# Altium schematic sheet Minion.SchDoc (part 2 of 4)
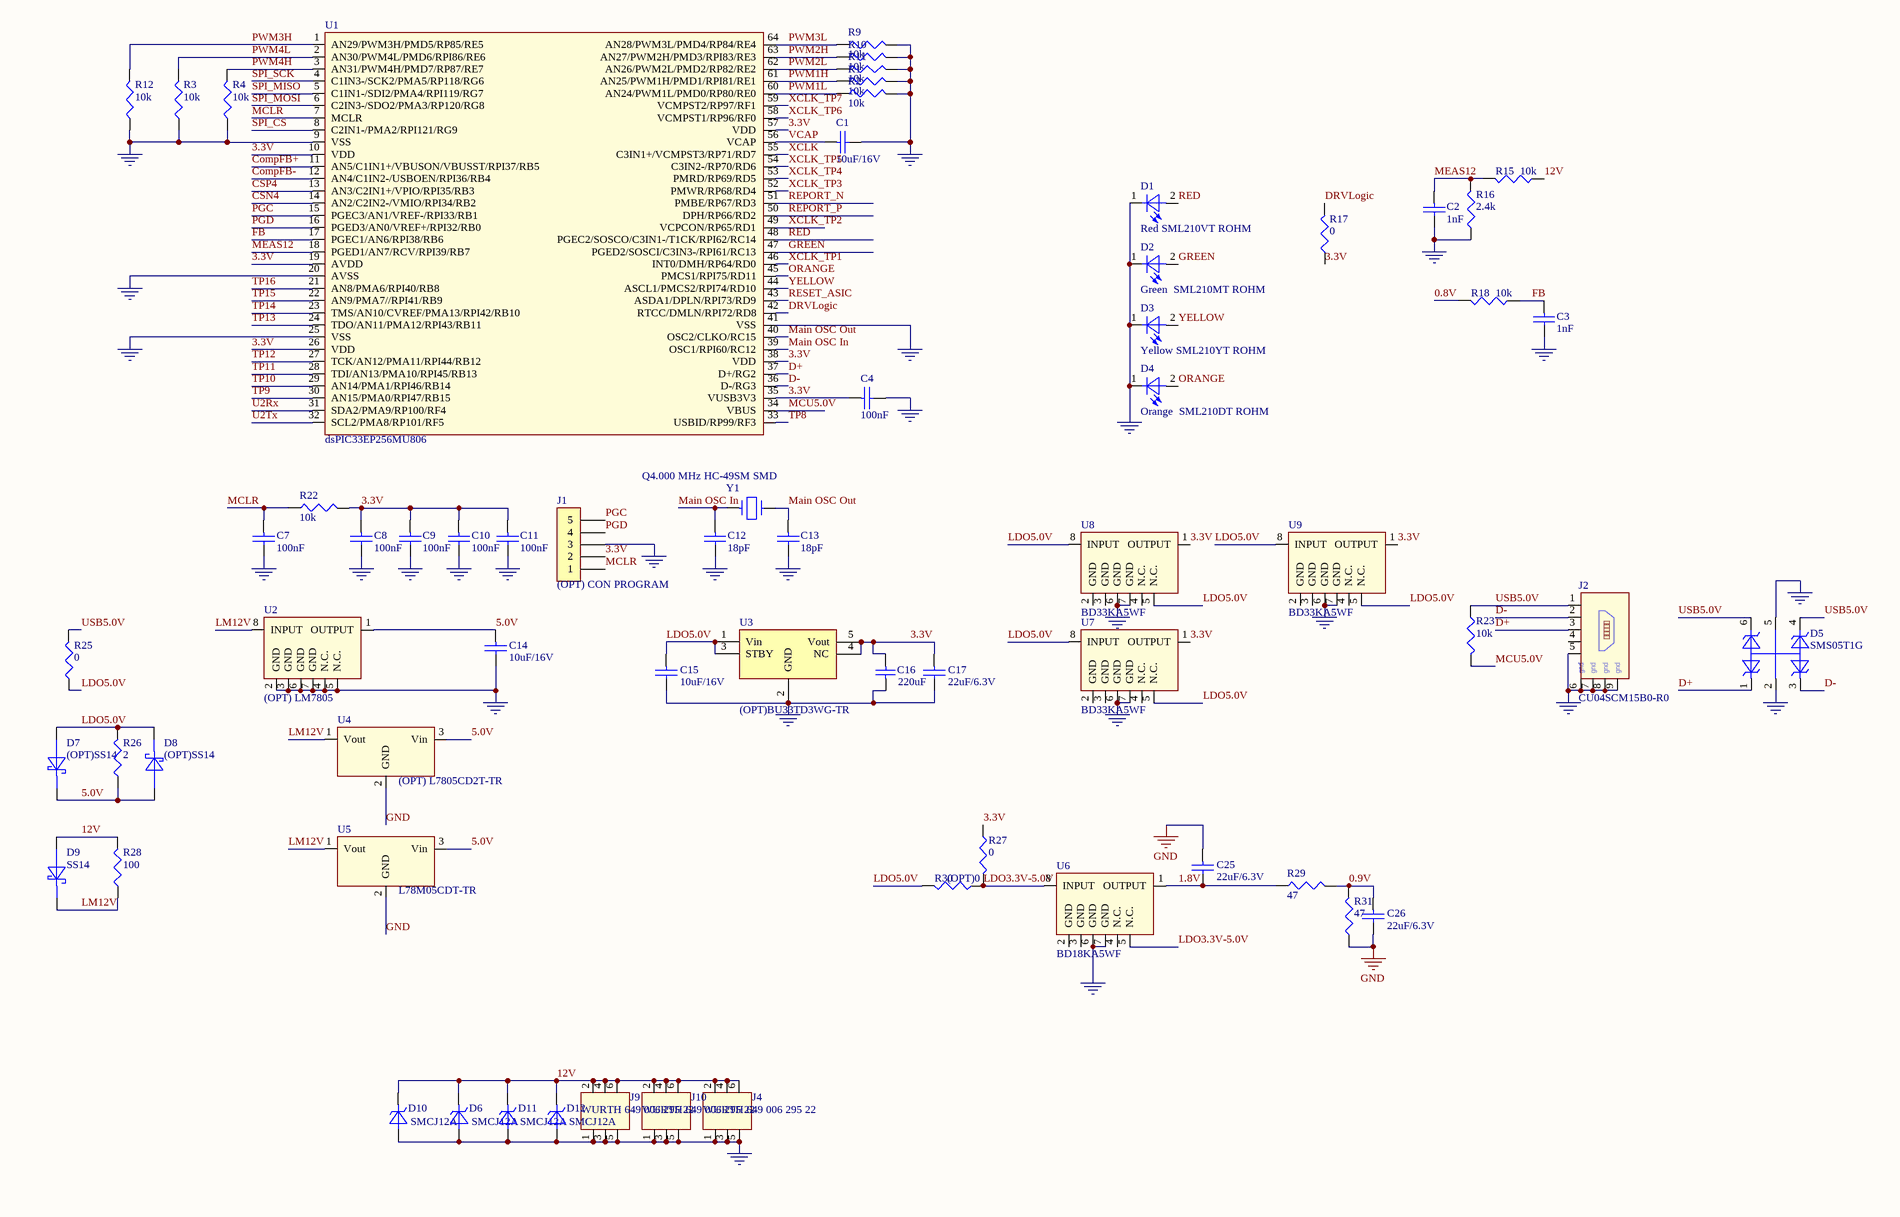
[diagram p6: Minion.SchDoc, bottom right]
## Nets
0.8V: C6P_1.1 C6P_2.1 C6P_3.1 C6P_4.1 C6P_5.1 C6P_6.1 C6P_7.1 C6P_8.1 C7P_1.1 C7P_2.1 C7P_3.1 C7P_4.1 C7P_5.1 C7P_6.1 C7P_7.1 C7P_8.1 C8P_1.1 C8P_2.1 C8P_3.1 C8P_4.1 C8P_5.1 C8P_6.1 C8P_7.1 C8P_8.1 CF_1.1 CF_2.1 CF_3.1 CF_4.1 CF_5.1 CF_6.1 CF_7.1 CF_8.1 CF_9.1 CF_10.1 CF_11.1 CF_12.1 CF_13.1 CF_14.1 CF_15.1 CF_16.1 CF_17.1 CF_18.1 CF_19.1 CF_20.1 CF_21.1 CF_22.1 CF_23.1 CF_24.1 CF_25.1 CF_26.1 CF_27.1 CF_28.1 CF_29.1 CF_30.1 CF_31.1 CF_32.1 CF_33.1 CF_34.1 CF_35.1 CF_36.1 CF_37.1 CF_38.1 CF_39.1 CF_40.1 CF_41.1 CF_42.1 CF_43.1 CF_44.1 CF_45.1 CF_46.1 CF_47.1 CF_48.1 CF_49.1 CF_50.1 CF_51.1 CF_52.1 CF_53.1 CF_54.1 CF_55.1 CF_56.1 CF_57.1 CF_58.1 CF_59.1 CF_60.1 CF_61.1 CF_62.1 CF_63.1 CF_64.1 CF_65.1 CF_66.1 CF_67.1 CF_68.1 CF_69.1 CF_70.1 CF_71.1 CF_72.1 CF_73.1 CF_74.1 CF_75.1 CF_76.1 CF_77.1 CF_78.1 CF_79.1 CF_80.1 CF_81.1 CF_82.1 CF_83.1 CF_84.1 CF_85.1 CF_86.1 CF_87.1 CF_88.1 CF_89.1 CF_90.1 CF_91.1 CF_92.1 CF_93.1 CF_94.1 CF_95.1 CF_96.1 CF_97.1 CF_98.1 CF_99.1 CF_100.1 CF_101.1 CF_102.1 CF_103.1 CF_104.1 CF_105.1 CF_106.1 CF_107.1 CF_108.1 CF_109.1 CF_110.1 CF_111.1 CF_112.1 CM_1.1 CM_2.1 CM_3.1 CM_4.1 CM_5.1 CM_6.1 CM_7.1 CM_8.1 CM_9.1 CM_10.1 CM_11.1 CM_12.1 CM_13.1 CM_14.1 CM_15.1 CM_16.1 CM_17.1 CM_18.1 CM_19.1 CM_20.1 CM_21.1 CM_22.1 CM_23.1 CM_24.1 CM_25.1 CM_26.1 CM_27.1 CM_28.1 CM_29.1 CM_30.1 CM_31.1 CM_32.1 CM_33.1 CM_34.1 CM_35.1 CM_36.1 CM_37.1 CM_38.1 CM_39.1 CM_40.1 CM_41.1 CM_42.1 CM_43.1 CM_44.1 CM_45.1 CM_46.1 CM_47.1 CM_48.1 CM_49.1 CM_50.1 CM_51.1 CM_52.1 CM_53.1 CM_54.1 CM_55.1 CM_56.1 CM_57.1 CM_58.1 CM_59.1 CM_60.1 CM_61.1 CM_62.1 CM_63.1 CM_64.1 CM_65.1 CM_66.1 CM_67.1 CM_68.1 CM_69.1 CM_70.1 CM_71.1 CM_72.1 CM_73.1 CM_74.1 CM_75.1 CM_76.1 CM_77.1 CM_78.1 CM_79.1 CM_80.1 CM_81.1 CM_82.1 CM_83.1 CM_84.1 CM_85.1 CM_86.1 CM_87.1 CM_88.1 CM_89.1 CM_90.1 CM_91.1 CM_92.1 CM_93.1 CM_94.1 CM_95.1 CM_96.1 CM_97.1 CM_98.1 CM_99.1 CM_100.1 CM_101.1 CM_102.1 CM_103.1 CM_104.1 CM_105.1 CM_106.1 CM_107.1 CM_108.1 CM_109.1 CM_110.1 CM_111.1 CM_112.1 L1P_1.2 L1P_2.2 L1P_3.2 L1P_4.2 L1P_5.2 L1P_6.2 L1P_7.2 L1P_8.2 R18.2 U1_1.A2(CORE_VDD) U1_1.A4(CORE_VDD) U1_1.A6(CORE_VDD) U1_1.A8(CORE_VDD) U1_1.A10(CORE_VDD) U1_1.A12(CORE_VDD) U1_1.A14(CORE_VDD) U1_1.A16(CORE_VDD) U1_1.A18(CORE_VDD) U1_1.A20(CORE_VDD) U1_1.A22(CORE_VDD) U1_1.A24(CORE_VDD) U1_1.A26(CORE_VDD) U1_1.A28(CORE_VDD) U1_1.A30(CORE_VDD) U1_1.AA2(CORE_VDD) U1_1.AA4(CORE_VDD) U1_1.AA6(CORE_VDD) U1_1.AA8(CORE_VDD) U1_1.AA10(CORE_VDD) U1_1.AA12(CORE_VDD) U1_1.AA14(CORE_VDD) U1_1.AA16(CORE_VDD) U1_1.AA18(CORE_VDD) U1_1.AA20(CORE_VDD) U1_1.AA22(CORE_VDD) U1_1.AA24(CORE_VDD) U1_1.AA26(CORE_VDD) U1_1.AA28(CORE_VDD) U1_1.AA30(CORE_VDD) U1_1.AB1(CORE_VDD) U1_1.AB3(CORE_VDD) U1_1.AB5(CORE_VDD) U1_1.AB7(CORE_VDD) U1_1.AB9(CORE_VDD) U1_1.AB11(CORE_VDD) U1_1.AB13(CORE_VDD) U1_1.AB15(CORE_VDD) U1_1.AB17(CORE_VDD) U1_1.AB19(CORE_VDD) U1_1.AB21(CORE_VDD) U1_1.AB23(CORE_VDD) U1_1.AB25(CORE_VDD) U1_1.AB27(CORE_VDD) U1_1.AB29(CORE_VDD) U1_1.AC2(CORE_VDD) U1_1.AC4(CORE_VDD) U1_1.AC6(CORE_VDD) U1_1.AC8(CORE_VDD) U1_1.AC10(CORE_VDD) U1_1.AC12(CORE_VDD) U1_1.AC14(CORE_VDD) U1_1.AC16(CORE_VDD) U1_1.AC18(CORE_VDD) U1_1.AC20(CORE_VDD) U1_1.AC22(CORE_VDD) U1_1.AC24(CORE_VDD) U1_1.AC26(CORE_VDD) U1_1.AC28(CORE_VDD) U1_1.AC30(CORE_VDD) U1_1.AD1(CORE_VDD) U1_1.AD3(CORE_VDD) U1_1.AD5(CORE_VDD) U1_1.AD7(CORE_VDD) U1_1.AD9(CORE_VDD) U1_1.AD11(CORE_VDD) U1_1.AD13(CORE_VDD) U1_1.AD15(CORE_VDD) U1_1.AD17(CORE_VDD) U1_1.AD19(CORE_VDD) U1_1.AD21(CORE_VDD) U1_1.AD23(CORE_VDD) U1_1.AD25(CORE_VDD) U1_1.AD27(CORE_VDD) U1_1.AD29(CORE_VDD) U1_1.AE2(CORE_VDD) U1_1.AE4(CORE_VDD) U1_1.AE6(CORE_VDD) U1_1.AE8(CORE_VDD) U1_1.AE10(CORE_VDD) U1_1.AE12(CORE_VDD) U1_1.AE14(CORE_VDD) U1_1.AE16(CORE_VDD) U1_1.AE18(CORE_VDD) U1_1.AE20(CORE_VDD) U1_1.AE22(CORE_VDD) U1_1.AE24(CORE_VDD) U1_1.AE26(CORE_VDD) U1_1.AE28(CORE_VDD) U1_1.AE30(CORE_VDD) U1_1.AF1(CORE_VDD) U1_1.AF3(CORE_VDD) U1_1.AF5(CORE_VDD) U1_1.AF7(CORE_VDD) U1_1.AF9(CORE_VDD) U1_1.AF11(CORE_VDD) U1_1.AF13(CORE_VDD) U1_1.AF15(CORE_VDD) U1_1.AF17(CORE_VDD) U1_1.AF19(CORE_VDD) U1_1.AF21(CORE_VDD) U1_1.AF23(CORE_VDD) U1_1.AF25(CORE_VDD) U1_1.AF27(CORE_VDD) U1_1.AF29(CORE_VDD) U1_1.AG2(CORE_VDD) U1_1.AG4(CORE_VDD) U1_1.AG6(CORE_VDD) U1_1.AG8(CORE_VDD) U1_1.AG10(CORE_VDD) U1_1.AG12(CORE_VDD) U1_1.AG14(CORE_VDD) U1_1.AG16(CORE_VDD) U1_1.AG18(CORE_VDD) U1_1.AG20(CORE_VDD) U1_1.AG22(CORE_VDD) U1_1.AG24(CORE_VDD) U1_1.AG26(CORE_VDD) U1_1.AG28(CORE_VDD) U1_1.AG30(CORE_VDD) U1_1.AH1(CORE_VDD) U1_1.AH3(CORE_VDD) U1_1.AH5(CORE_VDD) U1_1.AH7(CORE_VDD) U1_1.AH9(CORE_VDD) U1_1.AH11(CORE_VDD) U1_1.AH13(CORE_VDD) U1_1.AH15(CORE_VDD) U1_1.AH17(CORE_VDD) U1_1.AH19(CORE_VDD) U1_1.AH21(CORE_VDD) U1_1.AH23(CORE_VDD) U1_1.AH25(CORE_VDD) U1_1.AH27(CORE_VDD) U1_1.AH29(CORE_VDD) U1_1.AJ2(CORE_VDD) U1_1.AJ10(CORE_VDD) U1_1.AJ14(CORE_VDD) U1_1.AJ18(CORE_VDD) U1_1.AJ28(CORE_VDD) U1_1.AJ30(CORE_VDD) U1_1.AK1(CORE_VDD) U1_1.AK26(CORE_VDD) U1_1.AK29(CORE_VDD) U1_1.B1(CORE_VDD) U1_1.B3(CORE_VDD) U1_1.B5(CORE_VDD) U1_1.B7(CORE_VDD) U1_1.B9(CORE_VDD) U1_1.B11(CORE_VDD) U1_1.B13(CORE_VDD) U1_1.B15(CORE_VDD) U1_1.B17(CORE_VDD) U1_1.B19(CORE_VDD) U1_1.B21(CORE_VDD) U1_1.B23(CORE_VDD) U1_1.B25(CORE_VDD) U1_1.B27(CORE_VDD) U1_1.B29(CORE_VDD) U1_1.C2(CORE_VDD) U1_1.C4(CORE_VDD) U1_1.C6(CORE_VDD) U1_1.C8(CORE_VDD) U1_1.C10(CORE_VDD) U1_1.C12(CORE_VDD) U1_1.C14(CORE_VDD) U1_1.C16(CORE_VDD) U1_1.C18(CORE_VDD) U1_1.C20(CORE_VDD) U1_1.C22(CORE_VDD) U1_1.C24(CORE_VDD) U1_1.C26(CORE_VDD) U1_1.C28(CORE_VDD) U1_1.C30(CORE_VDD) U1_1.D1(CORE_VDD) U1_1.D3(CORE_VDD) U1_1.D5(CORE_VDD) U1_1.D7(CORE_VDD) U1_1.D9(CORE_VDD) U1_1.D11(CORE_VDD) U1_1.D13(CORE_VDD) U1_1.D15(CORE_VDD) U1_1.D17(CORE_VDD) U1_1.D19(CORE_VDD) U1_1.D21(CORE_VDD) U1_1.D23(CORE_VDD) U1_1.D25(CORE_VDD) U1_1.D27(CORE_VDD) U1_1.D29(CORE_VDD) U1_1.E2(CORE_VDD) U1_1.E4(CORE_VDD) U1_1.E6(CORE_VDD) U1_1.E8(CORE_VDD) U1_1.E10(CORE_VDD) U1_1.E12(CORE_VDD) U1_1.E14(CORE_VDD) U1_1.E16(CORE_VDD) U1_1.E18(CORE_VDD) U1_1.E20(CORE_VDD) U1_1.E22(CORE_VDD) U1_1.E24(CORE_VDD) U1_1.E26(CORE_VDD) U1_1.E28(CORE_VDD) U1_1.E30(CORE_VDD) U1_1.F1(CORE_VDD) U1_1.F3(CORE_VDD) U1_1.F5(CORE_VDD) U1_1.F7(CORE_VDD) U1_1.F9(CORE_VDD) U1_1.F11(CORE_VDD) U1_1.F13(CORE_VDD) U1_1.F15(CORE_VDD) U1_1.F17(CORE_VDD) U1_1.F19(CORE_VDD) U1_1.F21(CORE_VDD) U1_1.F23(CORE_VDD) U1_1.F25(CORE_VDD) U1_1.F27(CORE_VDD) U1_1.F29(CORE_VDD) U1_1.G2(CORE_VDD) U1_1.G4(CORE_VDD) U1_1.G6(CORE_VDD) U1_1.G8(CORE_VDD) U1_1.G10(CORE_VDD) U1_1.G12(CORE_VDD) U1_1.G14(CORE_VDD) U1_1.G16(CORE_VDD) U1_1.G18(CORE_VDD) U1_1.G20(CORE_VDD) U1_1.G22(CORE_VDD) U1_1.G24(CORE_VDD) U1_1.G26(CORE_VDD) U1_1.G28(CORE_VDD) U1_1.G30(CORE_VDD) U1_1.H1(CORE_VDD) U1_1.H3(CORE_VDD) U1_1.H5(CORE_VDD) U1_1.H7(CORE_VDD) U1_1.H9(CORE_VDD) U1_1.H11(CORE_VDD) U1_1.H13(CORE_VDD) U1_1.H15(CORE_VDD) U1_1.H17(CORE_VDD) U1_1.H19(CORE_VDD) U1_1.H21(CORE_VDD) U1_1.H23(CORE_VDD) U1_1.H25(CORE_VDD) U1_1.H27(CORE_VDD) U1_1.H29(CORE_VDD) U1_1.J2(CORE_VDD) U1_1.J4(CORE_VDD) U1_1.J6(CORE_VDD) U1_1.J8(CORE_VDD) U1_1.J10(CORE_VDD) U1_1.J12(CORE_VDD) U1_1.J14(CORE_VDD) U1_1.J16(CORE_VDD) U1_1.J18(CORE_VDD) U1_1.J20(CORE_VDD) U1_1.J22(CORE_VDD) U1_1.J24(CORE_VDD) U1_1.J26(CORE_VDD) U1_1.J28(CORE_VDD) U1_1.J30(CORE_VDD) U1_1.K1(CORE_VDD) U1_1.K3(CORE_VDD) U1_1.K5(CORE_VDD) U1_1.K7(CORE_VDD) U1_1.K9(CORE_VDD) U1_1.K11(CORE_VDD) U1_1.K13(CORE_VDD) U1_1.K15(CORE_VDD) U1_1.K17(CORE_VDD) U1_1.K19(CORE_VDD) U1_1.K21(CORE_VDD) U1_1.K23(CORE_VDD) U1_1.K25(CORE_VDD) U1_1.K27(CORE_VDD) U1_1.K29(CORE_VDD) U1_1.L2(CORE_VDD) U1_1.L4(CORE_VDD) U1_1.L6(CORE_VDD) U1_1.L8(CORE_VDD) U1_1.L10(CORE_VDD) U1_1.L12(CORE_VDD) U1_1.L14(CORE_VDD) U1_1.L16(CORE_VDD) U1_1.L18(CORE_VDD) U1_1.L20(CORE_VDD) U1_1.L22(CORE_VDD) U1_1.L24(CORE_VDD) U1_1.L26(CORE_VDD) U1_1.L28(CORE_VDD) U1_1.L30(CORE_VDD) U1_1.M1(CORE_VDD) U1_1.M3(CORE_VDD) U1_1.M5(CORE_VDD) U1_1.M7(CORE_VDD) U1_1.M9(CORE_VDD) U1_1.M11(CORE_VDD) U1_1.M13(CORE_VDD) U1_1.M15(CORE_VDD) U1_1.M17(CORE_VDD) U1_1.M19(CORE_VDD) U1_1.M21(CORE_VDD) U1_1.M23(CORE_VDD) U1_1.M25(CORE_VDD) U1_1.M27(CORE_VDD) U1_1.M29(CORE_VDD) U1_1.N2(CORE_VDD) U1_1.N4(CORE_VDD) U1_1.N6(CORE_VDD) U1_1.N8(CORE_VDD) U1_1.N10(CORE_VDD) U1_1.N12(CORE_VDD) U1_1.N14(CORE_VDD) U1_1.N16(CORE_VDD) U1_1.N18(CORE_VDD) U1_1.N20(CORE_VDD) U1_1.N22(CORE_VDD) U1_1.N24(CORE_VDD) U1_1.N26(CORE_VDD) U1_1.N28(CORE_VDD) U1_1.N30(CORE_VDD) U1_1.P1(CORE_VDD) U1_1.P3(CORE_VDD) U1_1.P5(CORE_VDD) U1_1.P7(CORE_VDD) U1_1.P9(CORE_VDD) U1_1.P11(CORE_VDD) U1_1.P13(CORE_VDD) U1_1.P15(CORE_VDD) U1_1.P17(CORE_VDD) U1_1.P19(CORE_VDD) U1_1.P21(CORE_VDD) U1_1.P23(CORE_VDD) U1_1.P25(CORE_VDD) U1_1.P27(CORE_VDD) U1_1.P29(CORE_VDD) U1_1.R2(CORE_VDD) U1_1.R4(CORE_VDD) U1_1.R6(CORE_VDD) U1_1.R8(CORE_VDD) U1_1.R10(CORE_VDD) U1_1.R12(CORE_VDD) U1_1.R14(CORE_VDD) U1_1.R16(CORE_VDD) U1_1.R18(CORE_VDD) U1_1.R20(CORE_VDD) U1_1.R22(CORE_VDD) U1_1.R24(CORE_VDD) U1_1.R26(CORE_VDD) U1_1.R28(CORE_VDD) U1_1.R30(CORE_VDD) U1_1.T1(CORE_VDD) U1_1.T3(CORE_VDD) U1_1.T5(CORE_VDD) U1_1.T7(CORE_VDD) U1_1.T9(CORE_VDD) U1_1.T11(CORE_VDD) U1_1.T13(CORE_VDD) U1_1.T15(CORE_VDD) U1_1.T17(CORE_VDD) U1_1.T19(CORE_VDD) U1_1.T21(CORE_VDD) U1_1.T23(CORE_VDD) U1_1.T25(CORE_VDD) U1_1.T27(CORE_VDD) U1_1.T29(CORE_VDD) U1_1.U2(CORE_VDD) U1_1.U4(CORE_VDD) U1_1.U6(CORE_VDD) U1_1.U8(CORE_VDD) U1_1.U10(CORE_VDD) U1_1.U12(CORE_VDD) U1_1.U14(CORE_VDD) U1_1.U16(CORE_VDD) U1_1.U18(CORE_VDD) U1_1.U20(CORE_VDD) U1_1.U22(CORE_VDD) U1_1.U24(CORE_VDD) U1_1.U26(CORE_VDD) U1_1.U28(CORE_VDD) U1_1.U30(CORE_VDD) U1_1.V1(CORE_VDD) U1_1.V3(CORE_VDD) U1_1.V5(CORE_VDD) U1_1.V7(CORE_VDD) U1_1.V9(CORE_VDD) U1_1.V11(CORE_VDD) U1_1.V13(CORE_VDD) U1_1.V15(CORE_VDD) U1_1.V17(CORE_VDD) U1_1.V19(CORE_VDD) U1_1.V21(CORE_VDD) U1_1.V23(CORE_VDD) U1_1.V25(CORE_VDD) U1_1.V27(CORE_VDD) U1_1.V29(CORE_VDD) U1_1.W2(CORE_VDD) U1_1.W4(CORE_VDD) U1_1.W6(CORE_VDD) U1_1.W8(CORE_VDD) U1_1.W10(CORE_VDD) U1_1.W12(CORE_VDD) U1_1.W14(CORE_VDD) U1_1.W16(CORE_VDD) U1_1.W18(CORE_VDD) U1_1.W20(CORE_VDD) U1_1.W22(CORE_VDD) U1_1.W24(CORE_VDD) U1_1.W26(CORE_VDD) U1_1.W28(CORE_VDD) U1_1.W30(CORE_VDD) U1_1.Y1(CORE_VDD) U1_1.Y3(CORE_VDD) U1_1.Y5(CORE_VDD) U1_1.Y7(CORE_VDD) U1_1.Y9(CORE_VDD) U1_1.Y11(CORE_VDD) U1_1.Y13(CORE_VDD) U1_1.Y15(CORE_VDD) U1_1.Y17(CORE_VDD) U1_1.Y19(CORE_VDD) U1_1.Y21(CORE_VDD) U1_1.Y23(CORE_VDD) U1_1.Y25(CORE_VDD) U1_1.Y27(CORE_VDD) U1_1.Y29(CORE_VDD) U1_2.A2(CORE_VDD) U1_2.A4(CORE_VDD) U1_2.A6(CORE_VDD) U1_2.A8(CORE_VDD) U1_2.A10(CORE_VDD) U1_2.A12(CORE_VDD) U1_2.A14(CORE_VDD) U1_2.A16(CORE_VDD) U1_2.A18(CORE_VDD) U1_2.A20(CORE_VDD) U1_2.A22(CORE_VDD) U1_2.A24(CORE_VDD) U1_2.A26(CORE_VDD) U1_2.A28(CORE_VDD) U1_2.A30(CORE_VDD) U1_2.AA2(CORE_VDD) U1_2.AA4(CORE_VDD) U1_2.AA6(CORE_VDD) U1_2.AA8(CORE_VDD) U1_2.AA10(CORE_VDD) U1_2.AA12(CORE_VDD) U1_2.AA14(CORE_VDD) U1_2.AA16(CORE_VDD) U1_2.AA18(CORE_VDD) U1_2.AA20(CORE_VDD) U1_2.AA22(CORE_VDD) U1_2.AA24(CORE_VDD) U1_2.AA26(CORE_VDD) U1_2.AA28(CORE_VDD) U1_2.AA30(CORE_VDD) U1_2.AB1(CORE_VDD) U1_2.AB3(CORE_VDD) U1_2.AB5(CORE_VDD) U1_2.AB7(CORE_VDD) U1_2.AB9(CORE_VDD) U1_2.AB11(CORE_VDD) U1_2.AB13(CORE_VDD) U1_2.AB15(CORE_VDD) U1_2.AB17(CORE_VDD) U1_2.AB19(CORE_VDD) U1_2.AB21(CORE_VDD) U1_2.AB23(CORE_VDD) U1_2.AB25(CORE_VDD) U1_2.AB27(CORE_VDD) U1_2.AB29(CORE_VDD) U1_2.AC2(CORE_VDD) U1_2.AC4(CORE_VDD) U1_2.AC6(CORE_VDD) U1_2.AC8(CORE_VDD) U1_2.AC10(CORE_VDD) U1_2.AC12(CORE_VDD) U1_2.AC14(CORE_VDD) U1_2.AC16(CORE_VDD) U1_2.AC18(CORE_VDD) U1_2.AC20(CORE_VDD) U1_2.AC22(CORE_VDD) U1_2.AC24(CORE_VDD) U1_2.AC26(CORE_VDD) U1_2.AC28(CORE_VDD) U1_2.AC30(CORE_VDD) U1_2.AD1(CORE_VDD) U1_2.AD3(CORE_VDD) U1_2.AD5(CORE_VDD) U1_2.AD7(CORE_VDD) U1_2.AD9(CORE_VDD) U1_2.AD11(CORE_VDD) U1_2.AD13(CORE_VDD) U1_2.AD15(CORE_VDD) U1_2.AD17(CORE_VDD) U1_2.AD19(CORE_VDD) U1_2.AD21(CORE_VDD) U1_2.AD23(CORE_VDD) U1_2.AD25(CORE_VDD) U1_2.AD27(CORE_VDD) U1_2.AD29(CORE_VDD) U1_2.AE2(CORE_VDD) U1_2.AE4(CORE_VDD) U1_2.AE6(CORE_VDD) U1_2.AE8(CORE_VDD) U1_2.AE10(CORE_VDD) U1_2.AE12(CORE_VDD) U1_2.AE14(CORE_VDD) U1_2.AE16(CORE_VDD) U1_2.AE18(CORE_VDD) U1_2.AE20(CORE_VDD) U1_2.AE22(CORE_VDD) U1_2.AE24(CORE_VDD) U1_2.AE26(CORE_VDD) U1_2.AE28(CORE_VDD) U1_2.AE30(CORE_VDD) U1_2.AF1(CORE_VDD) U1_2.AF3(CORE_VDD) U1_2.AF5(CORE_VDD) U1_2.AF7(CORE_VDD) U1_2.AF9(CORE_VDD) U1_2.AF11(CORE_VDD) U1_2.AF13(CORE_VDD) U1_2.AF15(CORE_VDD) U1_2.AF17(CORE_VDD) U1_2.AF19(CORE_VDD) U1_2.AF21(CORE_VDD) U1_2.AF23(CORE_VDD) U1_2.AF25(CORE_VDD) U1_2.AF27(CORE_VDD) U1_2.AF29(CORE_VDD) U1_2.AG2(CORE_VDD) U1_2.AG4(CORE_VDD) U1_2.AG6(CORE_VDD) U1_2.AG8(CORE_VDD) U1_2.AG10(CORE_VDD) U1_2.AG12(CORE_VDD) U1_2.AG14(CORE_VDD) U1_2.AG16(CORE_VDD) U1_2.AG18(CORE_VDD) U1_2.AG20(CORE_VDD) U1_2.AG22(CORE_VDD) U1_2.AG24(CORE_VDD) U1_2.AG26(CORE_VDD) U1_2.AG28(CORE_VDD) U1_2.AG30(CORE_VDD) U1_2.AH1(CORE_VDD) U1_2.AH3(CORE_VDD) U1_2.AH5(CORE_VDD) U1_2.AH7(CORE_VDD) U1_2.AH9(CORE_VDD) U1_2.AH11(CORE_VDD) U1_2.AH13(CORE_VDD) U1_2.AH15(CORE_VDD) U1_2.AH17(CORE_VDD) U1_2.AH19(CORE_VDD) U1_2.AH21(CORE_VDD) U1_2.AH23(CORE_VDD) U1_2.AH25(CORE_VDD) U1_2.AH27(CORE_VDD) U1_2.AH29(CORE_VDD) U1_2.AJ2(CORE_VDD) U1_2.AJ10(CORE_VDD) U1_2.AJ14(CORE_VDD) U1_2.AJ18(CORE_VDD) U1_2.AJ28(CORE_VDD) U1_2.AJ30(CORE_VDD) U1_2.AK1(CORE_VDD) U1_2.AK26(CORE_VDD) U1_2.AK29(CORE_VDD) U1_2.B1(CORE_VDD) U1_2.B3(CORE_VDD) U1_2.B5(CORE_VDD) U1_2.B7(CORE_VDD) U1_2.B9(CORE_VDD) U1_2.B11(CORE_VDD) U1_2.B13(CORE_VDD) U1_2.B15(CORE_VDD) U1_2.B17(CORE_VDD) U1_2.B19(CORE_VDD) U1_2.B21(CORE_VDD) U1_2.B23(CORE_VDD) U1_2.B25(CORE_VDD) U1_2.B27(CORE_VDD) U1_2.B29(CORE_VDD) U1_2.C2(CORE_VDD) U1_2.C4(CORE_VDD) U1_2.C6(CORE_VDD) U1_2.C8(CORE_VDD) U1_2.C10(CORE_VDD) U1_2.C12(CORE_VDD) U1_2.C14(CORE_VDD) U1_2.C16(CORE_VDD) U1_2.C18(CORE_VDD) U1_2.C20(CORE_VDD) U1_2.C22(CORE_VDD) U1_2.C24(CORE_VDD) U1_2.C26(CORE_VDD) U1_2.C28(CORE_VDD) U1_2.C30(CORE_VDD) U1_2.D1(CORE_VDD) U1_2.D3(CORE_VDD) U1_2.D5(CORE_VDD) U1_2.D7(CORE_VDD) U1_2.D9(CORE_VDD) U1_2.D11(CORE_VDD) U1_2.D13(CORE_VDD) U1_2.D15(CORE_VDD) U1_2.D17(CORE_VDD) U1_2.D19(CORE_VDD) U1_2.D21(CORE_VDD) U1_2.D23(CORE_VDD) U1_2.D25(CORE_VDD) U1_2.D27(CORE_VDD) U1_2.D29(CORE_VDD) U1_2.E2(CORE_VDD) U1_2.E4(CORE_VDD) U1_2.E6(CORE_VDD) U1_2.E8(CORE_VDD) U1_2.E10(CORE_VDD) U1_2.E12(CORE_VDD) U1_2.E14(CORE_VDD) U1_2.E16(CORE_VDD) U1_2.E18(CORE_VDD) U1_2.E20(CORE_VDD) U1_2.E22(CORE_VDD) U1_2.E24(CORE_VDD) U1_2.E26(CORE_VDD) U1_2.E28(CORE_VDD) U1_2.E30(CORE_VDD) U1_2.F1(CORE_VDD) U1_2.F3(CORE_VDD) U1_2.F5(CORE_VDD) U1_2.F7(CORE_VDD) U1_2.F9(CORE_VDD) U1_2.F11(CORE_VDD) U1_2.F13(CORE_VDD) U1_2.F15(CORE_VDD) U1_2.F17(CORE_VDD) U1_2.F19(CORE_VDD) U1_2.F21(CORE_VDD) U1_2.F23(CORE_VDD) U1_2.F25(CORE_VDD) U1_2.F27(CORE_VDD) U1_2.F29(CORE_VDD) U1_2.G2(CORE_VDD) U1_2.G4(CORE_VDD) U1_2.G6(CORE_VDD) U1_2.G8(CORE_VDD) U1_2.G10(CORE_VDD) U1_2.G12(CORE_VDD) U1_2.G14(CORE_VDD) U1_2.G16(CORE_VDD) U1_2.G18(CORE_VDD) U1_2.G20(CORE_VDD) U1_2.G22(CORE_VDD) U1_2.G24(CORE_VDD) U1_2.G26(CORE_VDD) U1_2.G28(CORE_VDD) U1_2.G30(CORE_VDD) U1_2.H1(CORE_VDD) U1_2.H3(CORE_VDD) U1_2.H5(CORE_VDD) U1_2.H7(CORE_VDD) U1_2.H9(CORE_VDD) U1_2.H11(CORE_VDD) U1_2.H13(CORE_VDD) U1_2.H15(CORE_VDD) U1_2.H17(CORE_VDD) U1_2.H19(CORE_VDD) U1_2.H21(CORE_VDD) U1_2.H23(CORE_VDD) U1_2.H25(CORE_VDD) U1_2.H27(CORE_VDD) U1_2.H29(CORE_VDD) U1_2.J2(CORE_VDD) U1_2.J4(CORE_VDD) U1_2.J6(CORE_VDD) U1_2.J8(CORE_VDD) U1_2.J10(CORE_VDD) U1_2.J12(CORE_VDD) U1_2.J14(CORE_VDD) U1_2.J16(CORE_VDD) U1_2.J18(CORE_VDD) U1_2.J20(CORE_VDD) U1_2.J22(CORE_VDD) U1_2.J24(CORE_VDD) U1_2.J26(CORE_VDD) U1_2.J28(CORE_VDD) U1_2.J30(CORE_VDD) U1_2.K1(CORE_VDD) U1_2.K3(CORE_VDD) U1_2.K5(CORE_VDD) U1_2.K7(CORE_VDD) U1_2.K9(CORE_VDD) U1_2.K11(CORE_VDD) U1_2.K13(CORE_VDD) U1_2.K15(CORE_VDD) U1_2.K17(CORE_VDD) U1_2.K19(CORE_VDD) U1_2.K21(CORE_VDD) U1_2.K23(CORE_VDD) U1_2.K25(CORE_VDD) U1_2.K27(CORE_VDD) U1_2.K29(CORE_VDD) U1_2.L2(CORE_VDD) U1_2.L4(CORE_VDD) U1_2.L6(CORE_VDD) U1_2.L8(CORE_VDD) U1_2.L10(CORE_VDD) U1_2.L12(CORE_VDD) U1_2.L14(CORE_VDD) U1_2.L16(CORE_VDD) U1_2.L18(CORE_VDD) U1_2.L20(CORE_VDD) U1_2.L22(CORE_VDD) U1_2.L24(CORE_VDD) U1_2.L26(CORE_VDD) U1_2.L28(CORE_VDD) U1_2.L30(CORE_VDD) U1_2.M1(CORE_VDD) U1_2.M3(CORE_VDD) U1_2.M5(CORE_VDD) U1_2.M7(CORE_VDD) U1_2.M9(CORE_VDD) U1_2.M11(CORE_VDD) U1_2.M13(CORE_VDD) U1_2.M15(CORE_VDD) U1_2.M17(CORE_VDD) U1_2.M19(CORE_VDD) U1_2.M21(CORE_VDD) U1_2.M23(CORE_VDD) U1_2.M25(CORE_VDD) U1_2.M27(CORE_VDD) U1_2.M29(CORE_VDD) U1_2.N2(CORE_VDD) U1_2.N4(CORE_VDD) U1_2.N6(CORE_VDD) U1_2.N8(CORE_VDD) U1_2.N10(CORE_VDD) U1_2.N12(CORE_VDD) U1_2.N14(CORE_VDD) U1_2.N16(CORE_VDD) U1_2.N18(CORE_VDD) U1_2.N20(CORE_VDD) U1_2.N22(CORE_VDD) U1_2.N24(CORE_VDD) U1_2.N26(CORE_VDD) U1_2.N28(CORE_VDD) U1_2.N30(CORE_VDD) U1_2.P1(CORE_VDD) U1_2.P3(CORE_VDD) U1_2.P5(CORE_VDD) U1_2.P7(CORE_VDD) U1_2.P9(CORE_VDD) U1_2.P11(CORE_VDD) U1_2.P13(CORE_VDD) U1_2.P15(CORE_VDD) U1_2.P17(CORE_VDD) U1_2.P19(CORE_VDD) U1_2.P21(CORE_VDD) U1_2.P23(CORE_VDD) U1_2.P25(CORE_VDD) U1_2.P27(CORE_VDD) U1_2.P29(CORE_VDD) U1_2.R2(CORE_VDD) U1_2.R4(CORE_VDD) U1_2.R6(CORE_VDD) U1_2.R8(CORE_VDD) U1_2.R10(CORE_VDD) U1_2.R12(CORE_VDD) U1_2.R14(CORE_VDD) U1_2.R16(CORE_VDD) U1_2.R18(CORE_VDD) U1_2.R20(CORE_VDD) U1_2.R22(CORE_VDD) U1_2.R24(CORE_VDD) U1_2.R26(CORE_VDD) U1_2.R28(CORE_VDD) U1_2.R30(CORE_VDD) U1_2.T1(CORE_VDD) U1_2.T3(CORE_VDD) U1_2.T5(CORE_VDD) U1_2.T7(CORE_VDD) U1_2.T9(CORE_VDD) U1_2.T11(CORE_VDD) U1_2.T13(CORE_VDD) U1_2.T15(CORE_VDD) U1_2.T17(CORE_VDD) U1_2.T19(CORE_VDD) U1_2.T21(CORE_VDD) U1_2.T23(CORE_VDD) U1_2.T25(CORE_VDD) U1_2.T27(CORE_VDD) U1_2.T29(CORE_VDD) U1_2.U2(CORE_VDD) U1_2.U4(CORE_VDD) U1_2.U6(CORE_VDD) U1_2.U8(CORE_VDD) U1_2.U10(CORE_VDD) U1_2.U12(CORE_VDD) U1_2.U14(CORE_VDD) U1_2.U16(CORE_VDD) U1_2.U18(CORE_VDD) U1_2.U20(CORE_VDD) U1_2.U22(CORE_VDD) U1_2.U24(CORE_VDD) U1_2.U26(CORE_VDD) U1_2.U28(CORE_VDD) U1_2.U30(CORE_VDD) U1_2.V1(CORE_VDD) U1_2.V3(CORE_VDD) U1_2.V5(CORE_VDD) U1_2.V7(CORE_VDD) U1_2.V9(CORE_VDD) U1_2.V11(CORE_VDD) U1_2.V13(CORE_VDD) U1_2.V15(CORE_VDD) U1_2.V17(CORE_VDD) U1_2.V19(CORE_VDD) U1_2.V21(CORE_VDD) U1_2.V23(CORE_VDD) U1_2.V25(CORE_VDD) U1_2.V27(CORE_VDD) U1_2.V29(CORE_VDD) U1_2.W2(CORE_VDD) U1_2.W4(CORE_VDD) U1_2.W6(CORE_VDD) U1_2.W8(CORE_VDD) U1_2.W10(CORE_VDD) U1_2.W12(CORE_VDD) U1_2.W14(CORE_VDD) U1_2.W16(CORE_VDD) U1_2.W18(CORE_VDD) U1_2.W20(CORE_VDD) U1_2.W22(CORE_VDD) U1_2.W24(CORE_VDD) U1_2.W26(CORE_VDD) U1_2.W28(CORE_VDD) U1_2.W30(CORE_VDD) U1_2.Y1(CORE_VDD) U1_2.Y3(CORE_VDD) U1_2.Y5(CORE_VDD) U1_2.Y7(CORE_VDD) U1_2.Y9(CORE_VDD) U1_2.Y11(CORE_VDD) U1_2.Y13(CORE_VDD) U1_2.Y15(CORE_VDD) U1_2.Y17(CORE_VDD) U1_2.Y19(CORE_VDD) U1_2.Y21(CORE_VDD) U1_2.Y23(CORE_VDD) U1_2.Y25(CORE_VDD) U1_2.Y27(CORE_VDD) U1_2.Y29(CORE_VDD) U1_3.A2(CORE_VDD) U1_3.A4(CORE_VDD) U1_3.A6(CORE_VDD) U1_3.A8(CORE_VDD) U1_3.A10(CORE_VDD) U1_3.A12(CORE_VDD) U1_3.A14(CORE_VDD) U1_3.A16(CORE_VDD) U1_3.A18(CORE_VDD) U1_3.A20(CORE_VDD) U1_3.A22(CORE_VDD) U1_3.A24(CORE_VDD) U1_3.A26(CORE_VDD) U1_3.A28(CORE_VDD) U1_3.A30(CORE_VDD) U1_3.AA2(CORE_VDD) U1_3.AA4(CORE_VDD) U1_3.AA6(CORE_VDD) U1_3.AA8(CORE_VDD) U1_3.AA10(CORE_VDD) U1_3.AA12(CORE_VDD) U1_3.AA14(CORE_VDD) U1_3.AA16(CORE_VDD) U1_3.AA18(CORE_VDD) U1_3.AA20(CORE_VDD) U1_3.AA22(CORE_VDD) U1_3.AA24(CORE_VDD) U1_3.AA26(CORE_VDD) U1_3.AA28(CORE_VDD) U1_3.AA30(CORE_VDD) U1_3.AB1(CORE_VDD) U1_3.AB3(CORE_VDD) U1_3.AB5(CORE_VDD) U1_3.AB7(CORE_VDD) U1_3.AB9(CORE_VDD) U1_3.AB11(CORE_VDD) U1_3.AB13(CORE_VDD) U1_3.AB15(CORE_VDD) U1_3.AB17(CORE_VDD) U1_3.AB19(CORE_VDD) U1_3.AB21(CORE_VDD) U1_3.AB23(CORE_VDD) U1_3.AB25(CORE_VDD) U1_3.AB27(CORE_VDD) U1_3.AB29(CORE_VDD) U1_3.AC2(CORE_VDD) U1_3.AC4(CORE_VDD) U1_3.AC6(CORE_VDD) U1_3.AC8(CORE_VDD) U1_3.AC10(CORE_VDD) U1_3.AC12(CORE_VDD) U1_3.AC14(CORE_VDD) U1_3.AC16(CORE_VDD) U1_3.AC18(CORE_VDD) U1_3.AC20(CORE_VDD) U1_3.AC22(CORE_VDD) U1_3.AC24(CORE_VDD) U1_3.AC26(CORE_VDD) U1_3.AC28(CORE_VDD) U1_3.AC30(CORE_VDD) U1_3.AD1(CORE_VDD) U1_3.AD3(CORE_VDD) U1_3.AD5(CORE_VDD) U1_3.AD7(CORE_VDD) U1_3.AD9(CORE_VDD) U1_3.AD11(CORE_VDD) U1_3.AD13(CORE_VDD) U1_3.AD15(CORE_VDD) U1_3.AD17(CORE_VDD) U1_3.AD19(CORE_VDD) U1_3.AD21(CORE_VDD) U1_3.AD23(CORE_VDD) U1_3.AD25(CORE_VDD) U1_3.AD27(CORE_VDD) U1_3.AD29(CORE_VDD) U1_3.AE2(CORE_VDD) U1_3.AE4(CORE_VDD) U1_3.AE6(CORE_VDD) U1_3.AE8(CORE_VDD) U1_3.AE10(CORE_VDD) U1_3.AE12(CORE_VDD) U1_3.AE14(CORE_VDD) U1_3.AE16(CORE_VDD) U1_3.AE18(CORE_VDD) 